# EasyEDA Pro project ESP32C3PowerKey.eprj (continued)
## Copper pours and planes (outline as drawn; the poured copper is in the pictures) (continued)
GND on Bottom Layer: -5.46,46.84 46.74,46.84 46.74,-3.96 -5.46,-3.96
VCC_3V3 on Top Layer: 22.1,25 26.29,25 27.31,23.98 30.23,23.98 30.23,21.87 27.1,21.87 26.67,21.44 22.1,21.44
VCC_3V3 on Top Layer: 17.02,35.77 15.65,35.77 15.62,35.79 15.62,37.16 11.78,37.16 11.78,39 17.02,39
VCC_3V3 on Top Layer: 22.1,23.22 22.1,15.85 28.11,15.85 28.11,19.32 27.53,19.89 27.53,21.99 26.31,23.22
VCC_3V3 on Bottom Layer: 22.14,23.22 22.14,15.85 28.15,15.85 28.15,19.32 27.57,19.89 27.57,21.99 26.35,23.22
VCC_3V3 on Bottom Layer: 22.1,25 26.29,25 27.31,23.98 30.23,23.98 30.23,21.87 27.1,21.87 26.67,21.44 22.1,21.44
VCC_3V3 on Bottom Layer: 16.97,35.83 15.6,35.83 15.57,35.85 15.57,37.22 11.73,37.22 11.73,39.06 16.97,39.06

Small or netless copper shapes (teardrops, artwork), in the pictures only: 50 on Top Layer, 13 on Bottom Layer

## Text on the board
Top Silkscreen Layer: H | L | ESP32C3_CAN_Host

# Board ESP32C3RLogo
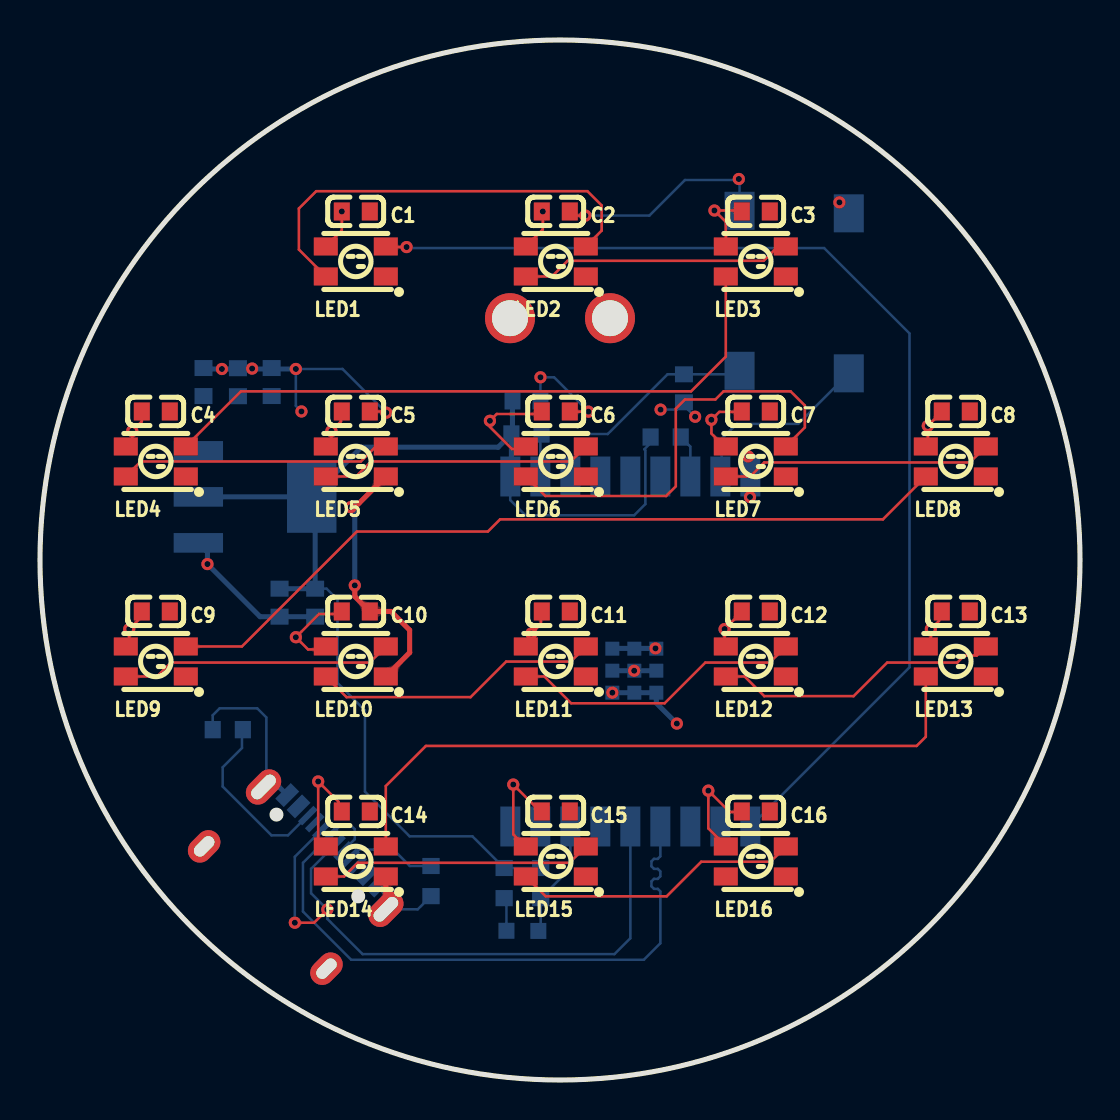
[diagram p5: board, top side]
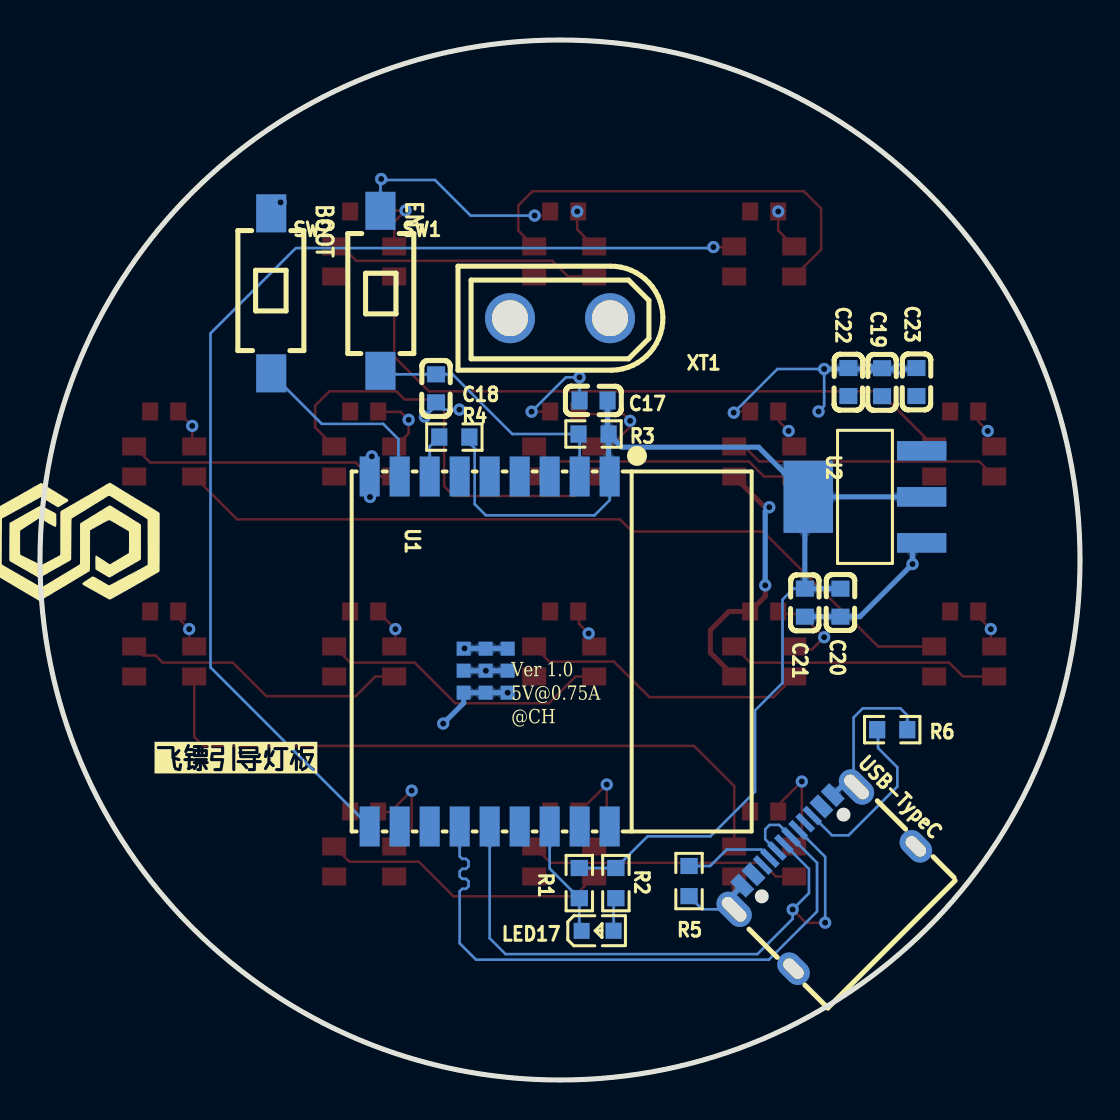
[diagram p6: board, bottom side, seen from below]

Outline 52 x 52 mm; copper layers: Top Layer, Bottom Layer. Coordinates in mm from the lower left corner of the outline.
Outline path: circle c26,26 r26
Stack: Top Layer 0.035mm / Dielectric1 1.51mm FR4 er 4.5 / Bottom Layer 0.035mm

## Design rules (mm)
net USB_DN: DP1
net USB_DP: DP1
template: 自定义配置
spacing copperThickness1oz (default): track to track 0.152, other pairs 0.152 to 0.3
spacing copperThickness2oz: track to track 0.203, other pairs 0.152 to 0.3
track width copperThickness1oz (default): min 0.127, default 0.254, max 2.54
track width copperThickness2oz: min 0.203, default 0.254, max 2.54
differential pair differentialPair (default): width min 0.127, default 0.254, max 2.54; gap min 0.152, default 0.152
via viaSize (default): diameter min 0.5, default 0.61, max 10; hole min 0.3, default 0.305, max 6.299

## Placement (name value [footprint] x y rotation side)
C1  100nF  [C0603]  15.79 43.43 0 top
C2  100nF  [C0603]  25.79 43.43 0 top
C3  100nF  [C0603]  35.79 43.43 0 top
C4  100nF  [C0603]  5.79 33.43 0 top
C5  100nF  [C0603]  15.79 33.43 0 top
C6  100nF  [C0603]  25.79 33.43 0 top
C7  100nF  [C0603]  35.79 33.43 0 top
C8  100nF  [C0603]  45.79 33.43 0 top
C9  100nF  [C0603]  5.79 23.43 0 top
C10  100nF  [C0603]  15.79 23.43 0 top
C11  100nF  [C0603]  25.79 23.43 0 top
C12  100nF  [C0603]  35.79 23.43 0 top
C13  100nF  [C0603]  45.79 23.43 0 top
C14  100nF  [C0603]  15.79 13.43 0 top
C15  100nF  [C0603]  25.79 13.43 0 top
C16  100nF  [C0603]  35.79 13.43 0 top
C17  100nF  [C0603]  24.32 33.98 180 bottom
C18  1uF  [C0603]  32.2 34.58 90 bottom
C19  10uF  [C0603]  9.9 34.89 90 bottom
C20  10uF  [C0603]  11.98 23.87 270 bottom
C21  0.1uF  [C0603]  13.76 23.87 90 bottom
C22  0.1uF  [C0603]  11.58 34.9 90 bottom
C23  10uF  [C0603]  8.18 34.9 270 bottom
LED1  XL-3528RGBW-WS2812B  [LED-SMD_4P-L3.5-W2.8-BR-1]  15.79 40.93 0 top
LED2  XL-3528RGBW-WS2812B  [LED-SMD_4P-L3.5-W2.8-BR-1]  25.79 40.93 0 top
LED3  XL-3528RGBW-WS2812B  [LED-SMD_4P-L3.5-W2.8-BR-1]  35.79 40.93 0 top
LED4  XL-3528RGBW-WS2812B  [LED-SMD_4P-L3.5-W2.8-BR-1]  5.79 30.93 0 top
LED5  XL-3528RGBW-WS2812B  [LED-SMD_4P-L3.5-W2.8-BR-1]  15.79 30.93 0 top
LED6  XL-3528RGBW-WS2812B  [LED-SMD_4P-L3.5-W2.8-BR-1]  25.79 30.93 0 top
LED7  XL-3528RGBW-WS2812B  [LED-SMD_4P-L3.5-W2.8-BR-1]  35.79 30.93 0 top
LED8  XL-3528RGBW-WS2812B  [LED-SMD_4P-L3.5-W2.8-BR-1]  45.79 30.93 0 top
LED9  XL-3528RGBW-WS2812B  [LED-SMD_4P-L3.5-W2.8-BR-1]  5.79 20.93 0 top
LED10  XL-3528RGBW-WS2812B  [LED-SMD_4P-L3.5-W2.8-BR-1]  15.79 20.93 0 top
LED11  XL-3528RGBW-WS2812B  [LED-SMD_4P-L3.5-W2.8-BR-1]  25.79 20.93 0 top
LED12  XL-3528RGBW-WS2812B  [LED-SMD_4P-L3.5-W2.8-BR-1]  35.79 20.93 0 top
LED13  XL-3528RGBW-WS2812B  [LED-SMD_4P-L3.5-W2.8-BR-1]  45.79 20.93 0 top
LED14  XL-3528RGBW-WS2812B  [LED-SMD_4P-L3.5-W2.8-BR-1]  15.79 10.93 0 top
LED15  XL-3528RGBW-WS2812B  [LED-SMD_4P-L3.5-W2.8-BR-1]  25.79 10.93 0 top
LED16  XL-3528RGBW-WS2812B  [LED-SMD_4P-L3.5-W2.8-BR-1]  35.79 10.93 0 top
LED17  NCD0603R1  [LED0603-RD_RED]  24.12 7.46 180 bottom
R1  10kΩ  [R0603]  25.03 9.85 270 bottom
R2  1kΩ  [R0603]  23.21 9.85 90 bottom
R3  10kΩ  [R0603]  24.32 32.3 180 bottom
R4  10kΩ  [R0603]  31.28 32.15 180 bottom
R5  5.1kΩ  [R0603]  19.55 9.95 90 bottom
R6  5.1kΩ  [R0603]  9.39 17.52 0 bottom
SW1  TS-1101-C-W  [SW-SMD_L6.0-W3.3-LS8.0]  34.98 39.46 90 bottom
SW2  TS-1101-C-W  [SW-SMD_L6.0-W3.3-LS8.0]  40.44 39.33 270 bottom
U1  2.4GHz  [BULETM-SMD_ESPRESSIF_ESP32-C3-WROOM-02-N4-4MB]  29.52 21.43 270 bottom
U2  AMS1117-3.3  [SOT-223-4_L6.5-W3.5-P2.30-LS7.0-BR]  10.75 29.16 180 bottom
USB-TypeC  TYPE-C 16PIN 2MD(073)  [USB-C-SMD_TYPE-C-6PIN-2MD-073]  12.94 10.3 135 bottom
XT1  XT30UPB-M  [CONN-TH_XT30UPB-M]  26 38.09 0 bottom

## Footprints (pads in the part's own frame, mm; a bottom-side part is the same pattern mirrored in y, then rotated)
BULETM-SMD_ESPRESSIF_ESP32-C3-WROOM-02-N4-4MB
  rect 2x1 smd: 1(-8.75,6) 2(-8.75,4.5) 3(-8.75,3) 4(-8.75,1.5) 5(-8.75,0) 6(-8.75,-1.5) 7(-8.75,-3) 8(-8.75,-4.5) 9(-8.75,-6) 10(8.75,-6) 11(8.75,-4.5) 12(8.75,-3) 13(8.75,-1.5) 14(8.75,0) 15(8.75,1.5) 16(8.75,3) 17(8.75,4.5) 18(8.75,6)
  rect 0.7x0.7 smd: 19(-0.14,-1.3) 19(-0.14,-0.2) 19(-0.14,0.9) 19(0.96,-1.3) 19(0.96,-0.2) 19(0.96,0.9) 19(2.06,-1.3) 19(2.06,-0.2) 19(2.06,0.9)
C0603
  rect 0.8x0.9 smd: 1(-0.7,0) 2(0.7,0)
CONN-TH_XT30UPB-M
  round 2.5 hole 1.8: 1(-2.5,0) 2(2.5,0)
LED0603-RD_RED
  rect 0.8x0.8 smd: 1(-0.799,-0.004) 2(0.799,0.004)
LED-SMD_4P-L3.5-W2.8-BR-1
  rect 1.2x0.9 smd: 1(1.5,-0.75) 2(1.5,0.75) 3(-1.5,0.75) 4(-1.5,-0.75)
R0603
  rect 0.806x0.864 smd: 1(-0.753,0) 2(0.753,0)
SOT-223-4_L6.5-W3.5-P2.30-LS7.0-BR
  rect 2.47x0.98 smd: 1(2.835,-2.3) 2(2.835,0) 3(2.835,2.3)
  rect 2.47x3.6 smd: 4(-2.835,0)
SW-SMD_L6.0-W3.3-LS8.0
  rect 1.9x1.5 smd: 1(-4,0) 2(4,0)
USB-C-SMD_TYPE-C-6PIN-2MD-073
  rect 0.6x1.1 smd: 1(-3.2,2.375) 2(-2.4,2.375) 11(2.4,2.375) 12(3.2,2.375)
  rect 0.3x1.1 smd: 3(-1.75,2.375) 4(-1.25,2.375) 5(-0.75,2.375) 6(-0.25,2.375) 7(0.25,2.375) 8(0.75,2.375) 9(1.25,2.375) 10(1.75,2.375)
  oval 1.2x1.8 hole 0.6x1.2: 13(-4.325,-2.375) 14(4.325,-2.375)
  oval 1.2x2 hole 0.6x1.5: 13(-4.325,1.825) 14(4.325,1.825)

## Nets
GND: C1.2 C2.2 C3.2 C4.2 C5.2 C6.2 C7.2 C8.2 C9.2 C10.2 C11.2 C12.2 C13.2 C14.2 C15.2 C16.2 C17.1 C18.1 C19.2 C20.2 C21.1 C22.2 C23.1 LED1.1 LED2.1 LED3.1 LED4.1 LED5.1 LED6.1 LED7.1 LED8.1 LED9.1 LED10.1 LED11.1 LED12.1 LED13.1 LED14.1 LED15.1 LED16.1 R5.1 R6.1 SW1.2 SW2.1 U1.9 U1.19 U2.1 USB-TypeC.1 USB-TypeC.12 USB-TypeC.13 USB-TypeC.14 XT1.1
VCC: C1.1 C2.1 C3.1 C4.1 C5.1 C6.1 C7.1 C8.1 C9.1 C10.1 C11.1 C12.1 C13.1 C14.1 C15.1 C16.1 C19.1 C22.1 C23.2 LED1.3 LED2.3 LED3.3 LED4.3 LED5.3 LED6.3 LED7.3 LED8.3 LED9.3 LED10.3 LED11.3 LED12.3 LED13.3 LED14.3 LED15.3 LED16.3 U2.3 USB-TypeC.2 USB-TypeC.11 XT1.2
VCC_3V3: C17.2 C20.1 C21.2 R1.1 R2.2 R3.2 R4.2 U1.1 U2.2 U2.4
$1I10440/DO: LED16.4
BOOT: SW2.2 U1.8
DIN: LED1.2 U1.10
EN: C18.2 R3.1 SW1.1 U1.2
USB_DN: U1.13 USB-TypeC.5 USB-TypeC.7
USB_DP: U1.14 USB-TypeC.6 USB-TypeC.8
$1N821: R4.1 U1.7
$1N839: LED17.1 R1.2 U1.16
$1N846: LED17.2 R2.1
$1N1163: R5.2 USB-TypeC.4
$1N1164: R6.2 USB-TypeC.10
$1N10754: LED1.4 LED2.2
$1N10755: LED2.4 LED3.2
$1N10761: LED4.4 LED5.2
$1N10762: LED5.4 LED6.2
$1N10763: LED7.4 LED8.2
$1N10765: LED6.4 LED7.2
$1N10771: LED10.4 LED11.2
$1N10772: LED11.4 LED12.2
$1N10773: LED12.4 LED13.2
$1N10775: LED9.4 LED10.2
$1N10778: LED14.4 LED15.2
$1N10779: LED15.4 LED16.2
$1N13502: LED13.4 LED14.2
$1N13509: LED8.4 LED9.2
$1N13512: LED3.4 LED4.2

Pads without a net: U1 3 4 5 6 11 12 15 17 18; USB-TypeC 3 9

## Via types
v1: diameter 0.61, hole 0.305, Top Layer to Bottom Layer, 40 vias

## Routing (per net, layer and track width the routed paths; a pad name or vN(x,y) marks a point on that pad's centre or on a via; arc(x,y) is an arc through that point)
GND: length 75.1
  Top Layer w0.127: v1(27.42,33.42) 26.5,33.42 C6.2 ; C5.2 17.25,33.43 v1(17.31,33.37) ; v1(27.27,43.22) 26.69,43.22 C2.2
  Top Layer w0.254: 17.29,8.53 17.29,10.17 LED14.1 ; v1(15.74,24.73) 15.74,24.18 C10.2 17.55,23.43 18.48,22.5 18.48,21.37 LED10.1 ; v1(15.53,28.64) 15.76,28.64 LED5.1
  Bottom Layer w0.127: v1(17.31,33.37) 15.13,35.55 v1(12.79,35.55) 12.79,33.71 v1(13.07,33.43) ; 17.29,8.53 18.89,8.53 R5.1 ; v1(27.42,33.42) 25.7,35.13 v1(25.02,35.13) C17.1 ; v1(31.03,33.52) 31.83,33.52 C18.1 32.2,33.72 v1(32.76,33.16) ; R6.1 8.63,18.24 8.98,18.58 10.86,18.58 11.32,18.13 11.32,14.79 USB-TypeC.14 ; SW1.2 34.98,45.01 v1(34.94,45.05) 34.89,45 32.25,45 30.47,43.22 v1(27.27,43.22) ; 28.63,21.58 U1.19
  Bottom Layer w0.254: v1(30.78,21.58) 28.63,21.58 ; v1(28.62,19.37) U1.19 U1.19 30.82,18.85 v1(31.84,17.82) ; U1.19 30.81,20.46 v1(29.71,20.46) 29.71,20.47 U1.19 ; USB-TypeC.1 17.29,9.31 17.29,8.53 ; U2.1 8.37,26.4 v1(8.37,25.8) 11,23.17 C20.2 C21.1 ; USB-TypeC.14 11.95,14.65 12.36,14.25 ; v1(15.74,24.73) 15.74,28.44 v1(15.53,28.64) ; C23.1 8.22,35.55 v1(9.09,35.55) v1(12.79,35.55)
  vias: v1(10.61,35.57) v1(35.41,31.18) v1(35.5,29.15) v1(39.97,43.88)
VCC: length 50.8
  Top Layer w0.127: 4.24,21.82 4.46,22.04 v1(4.46,22.55) 5.04,23.12 5.04,23.57 ; 35.17,23.49 v1(34.23,22.55) 34.23,21.88 34.37,21.74 ; 14.25,31.68 14.57,32 v1(14.57,32.45) 15.05,32.93 15.05,33.43 ; 34.24,31.66 33.57,32.33 v1(33.57,33.01) 33.96,33.41 35.04,33.41 ; 44.15,21.72 44.54,22.11 v1(44.54,22.55) 44.95,22.96 44.95,23.47 ; 45.07,33.46 45.07,33.39 v1(44.39,32.71) 44.39,31.83 44.27,31.71 ; 25.02,33.3 22.84,33.3 v1(22.5,32.96) 22.5,32.66 23.6,31.55 24.22,31.55 ; LED1.3 15.09,42.48 v1(15.09,43.43) ; 35.15,13.4 34.49,13.4 v1(33.42,14.47) 33.42,12.58 34.35,11.65 ; 24.25,21.55 24.57,21.87 v1(24.57,22.33) 25.04,22.8 25.04,23.3 ; 14.94,23.3 13.95,23.3 v1(12.79,22.14) 13.4,21.53 14.16,21.53 ; 14.12,11.74 13.91,11.96 v1(13.91,14.93) 14.92,13.91 14.92,13.49 ; LED2.3 25.14,42.53 v1(25.14,43.43) ; C3.1 35.04,43.47 v1(33.72,43.47) 34.29,42.91 LED3.3 ; LED4.3 4.61,32 v1(4.61,32.45) 5.09,32.93 C4.1 ; 25.09,13.4 25.04,13.4 v1(23.66,14.77) 23.66,12.28 24.29,11.65
VCC_3V3: length 61.1
  Bottom Layer w0.127: R4.2 30.53,31.85 30.22,31.54 30.27,31.49 30.27,28.79 29.71,28.23 24.27,28.23 23.51,29 23.51,30.17 U1.1 ; C21.2 14.33,24.57 14.88,24.02 14.88,19.85 16.25,18.48 16.25,14.42 18.48,12.18 21.62,12.18 R2.2 R1.1
  Bottom Layer w0.254: U1.1 23.57,30.23 R3.2 ; U2.4 13.76,28.99 C21.2 C20.1 ; U2.4 16.07,31.64 22.91,31.64 R3.2 ; U2.4 U2.2 ; R3.2 23.62,32.35 C17.2
BOOT: length 9.6
  Bottom Layer w0.127: SW2.2 37.91,32.81 34.84,32.81 34.08,32.05 34.08,30.24 U1.8
DIN: length 55.9
  Top Layer w0.127: v1(18.33,41.65) 17.32,41.65 LED1.2
  Bottom Layer w0.127: U1.10 43.47,20.63 43.47,37.33 39.21,41.6 18.38,41.6 v1(18.33,41.65)
EN: length 13.4
  Bottom Layer w0.127: SW1.1 34.8,35.28 C18.2 31.37,35.28 28.39,32.3 R3.1 25.02,32.24 U1.2
USB_DN: length 33.5
  Bottom Layer w0.127: U1.13 31.02,11.18 30.89,11.06 30.7,11.06 30.57,10.93 30.57,10.68 30.7,10.56 30.89,10.56 31.02,10.43 31.02,10.18 30.89,10.06 30.7,10.06 30.57,9.93 30.57,9.68 30.7,9.56 30.89,9.56 31.02,9.43 31.02,6.84 30.19,6.01 15.56,6.01 13.15,8.42 13.15,10.86 USB-TypeC.7 15.04,12.75 15.52,12.75 15.74,12.54 15.74,12.04 USB-TypeC.5
USB_DP: length 33.5
  Top Layer w0.127: v1(12.74,7.86) 13.71,7.86 v1(14.37,8.53)
  Bottom Layer w0.127: v1(12.74,7.86) 12.74,11.16 USB-TypeC.8 ; U1.14 29.52,7.09 28.72,6.29 16.13,6.29 14.37,8.06 v1(14.37,8.53) 13.55,9.34 13.55,10.56 USB-TypeC.6
$1N821: length 2.2
  Bottom Layer w0.127: R4.1 32.52,31.67 U1.7
$1N839: length 5.9
  Bottom Layer w0.127: U1.16 26.52,10.57 R1.2 25.03,7.57 LED17.1
$1N846: length 1.7
  Bottom Layer w0.127: R2.1 23.32,8.98 LED17.2
$1N1163: length 4.6
  Bottom Layer w0.127: R5.2 18.49,10.7 17.67,11.52 15.93,11.52 USB-TypeC.4
$1N1164: length 8.9
  Bottom Layer w0.127: USB-TypeC.10 12.4,12.23 11.57,12.23 9.13,14.67 9.13,15.64 10.1,16.6 10.1,17.47 R6.2
$1N10754: length 22.1
  Top Layer w0.127: LED1.4 12.94,41.52 12.94,43.58 13.81,44.44 27.37,44.44 28.08,43.73 28.08,42.47 LED2.2
$1N10755: length 13.6
  Top Layer w0.127: LED3.2 36.9,41.68 36.19,40.96 26.38,40.96 25.6,40.18 LED2.4
$1N10761: length 13.6
  Top Layer w0.127: LED4.4 5.04,30.93 16.04,30.93 16.79,31.68 LED5.2
$1N10762: length 13.6
  Top Layer w0.127: LED6.2 26.54,30.93 16.55,30.93 15.8,30.18 LED5.4
$1N10763: length 13.6
  Top Layer w0.127: LED7.4 35.51,30.18 36.21,30.88 46.49,30.88 LED8.2
$1N10765: length 21.5
  Top Layer w0.127: LED7.2 38.24,32.63 38.24,33.72 37.53,34.43 34.18,34.43 33.77,34.03 32.25,34.03 31.79,33.57 31.79,29.69 31.31,29.2 25.27,29.2 LED6.4
$1N10771: length 14.5
  Top Layer w0.127: LED10.4 15.32,19.14 21.53,19.14 23.31,20.92 26.53,20.92 LED11.2
$1N10772: length 14.7
  Top Layer w0.127: LED11.4 25.22,20.18 26.56,18.84 31.23,18.84 33.26,20.87 36.48,20.87 LED12.2
$1N10773: length 14.4
  Top Layer w0.127: LED13.2 46.84,21.22 46.22,21.22 45.86,20.87 42.36,20.87 40.68,19.19 36.21,19.19 35.23,20.18 LED12.4
$1N10775: length 13.6
  Top Layer w0.127: LED9.4 5.85,20.18 6.54,20.87 16.48,20.87 LED10.2
$1N10778: length 13.6
  Top Layer w0.127: LED14.4 15.21,10.18 15.89,10.86 26.47,10.86 LED15.2
$1N10779: length 14.4
  Top Layer w0.127: LED15.4 25.28,9.19 31.33,9.19 33.06,10.91 36.53,10.91 LED16.2
$1N13502: length 34.1
  Top Layer w0.127: LED14.2 17.29,14.7 19.29,16.7 43.83,16.7 44.29,17.16 LED13.4
$1N13509: length 40.5
  Top Layer w0.127: LED9.2 10.09,21.68 15.84,27.42 22.39,27.42 23,28.03 42.15,28.03 LED8.4
$1N13512: length 32.9
  Top Layer w0.127: LED4.2 10.05,34.43 32.55,34.43 34.29,36.17 LED3.4

## Copper pours and planes (outline as drawn; the poured copper is in the pictures)
GND on Top Layer: -5.75,54.45 62.12,54.45 62.12,-1.74 -5.75,-1.74
VCC on Bottom Layer: -4.58,53.28 55.16,53.28 55.16,-0.82 -4.58,-0.82

Small or netless copper shapes (teardrops, artwork), in the pictures only: 104 on Top Layer, 117 on Bottom Layer

## Text on the board
Bottom Silkscreen Layer: EN | BOOT | Ver 1.0 / 5V@0.75A / @CH | 飞镖引导灯板

# Board LED_WS2812B
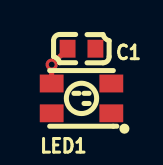
[diagram p7: board, top side]
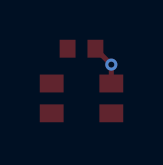
[diagram p8: board, bottom side, seen from below]

No outline. copper layers: Top Layer, Bottom Layer. Coordinates in mm from the lowest, leftmost part position.
Stack: Top Layer 0.035mm / Dielectric1 1.51mm FR4 er 4.5 / Bottom Layer 0.035mm

## Design rules (mm)
template: JLCPCB Capability(Two Layers Board)
spacing copperThickness1oz (default): track to track 0.102, other pairs 0.152 to 0.3
spacing copperThickness2oz: track to track 0.203, other pairs 0.152 to 0.3
track width copperThickness1oz (default): min 0.127, default 0.254, max 2.54
track width copperThickness2oz: min 0.203, default 0.254, max 2.54
differential pair differentialPair (default): width min 0.127, default 0.254, max 2.54; gap min 0.152, default 0.152
via viaSize (default): diameter min 0.5, default 0.61, max 10; hole min 0.3, default 0.305, max 6.3

## Placement (name value [footprint] x y rotation side)
C1  100nF  [C0603]  0 2.5 0 top
LED1  XL-3528RGBW-WS2812B  [LED-SMD_4P-L3.5-W2.8-BR-1]  0 0 0 top

## Footprints (pads in the part's own frame, mm; a bottom-side part is the same pattern mirrored in y, then rotated)
C0603
  rect 0.8x0.9 smd: 1(-0.7,0) 2(0.7,0)
LED-SMD_4P-L3.5-W2.8-BR-1
  rect 1.2x0.9 smd: 1(1.5,-0.75) 2(1.5,0.75) 3(-1.5,0.75) 4(-1.5,-0.75)

## Nets
As in the schematic.

## Via types
v1: diameter 0.61, hole 0.305, Top Layer to Bottom Layer, 1 via

## Routing (per net, layer and track width the routed paths; a pad name or vN(x,y) marks a point on that pad's centre or on a via; arc(x,y) is an arc through that point)
VCC: length 2.1
  Top Layer w0.254: LED1.3 v1(-1.5,1.7) C1.1
